# Altium schematic sheet Intel16_UNI3_Q1.SchDoc
size A3; SheetNumber: 11; SheetTotal: 15
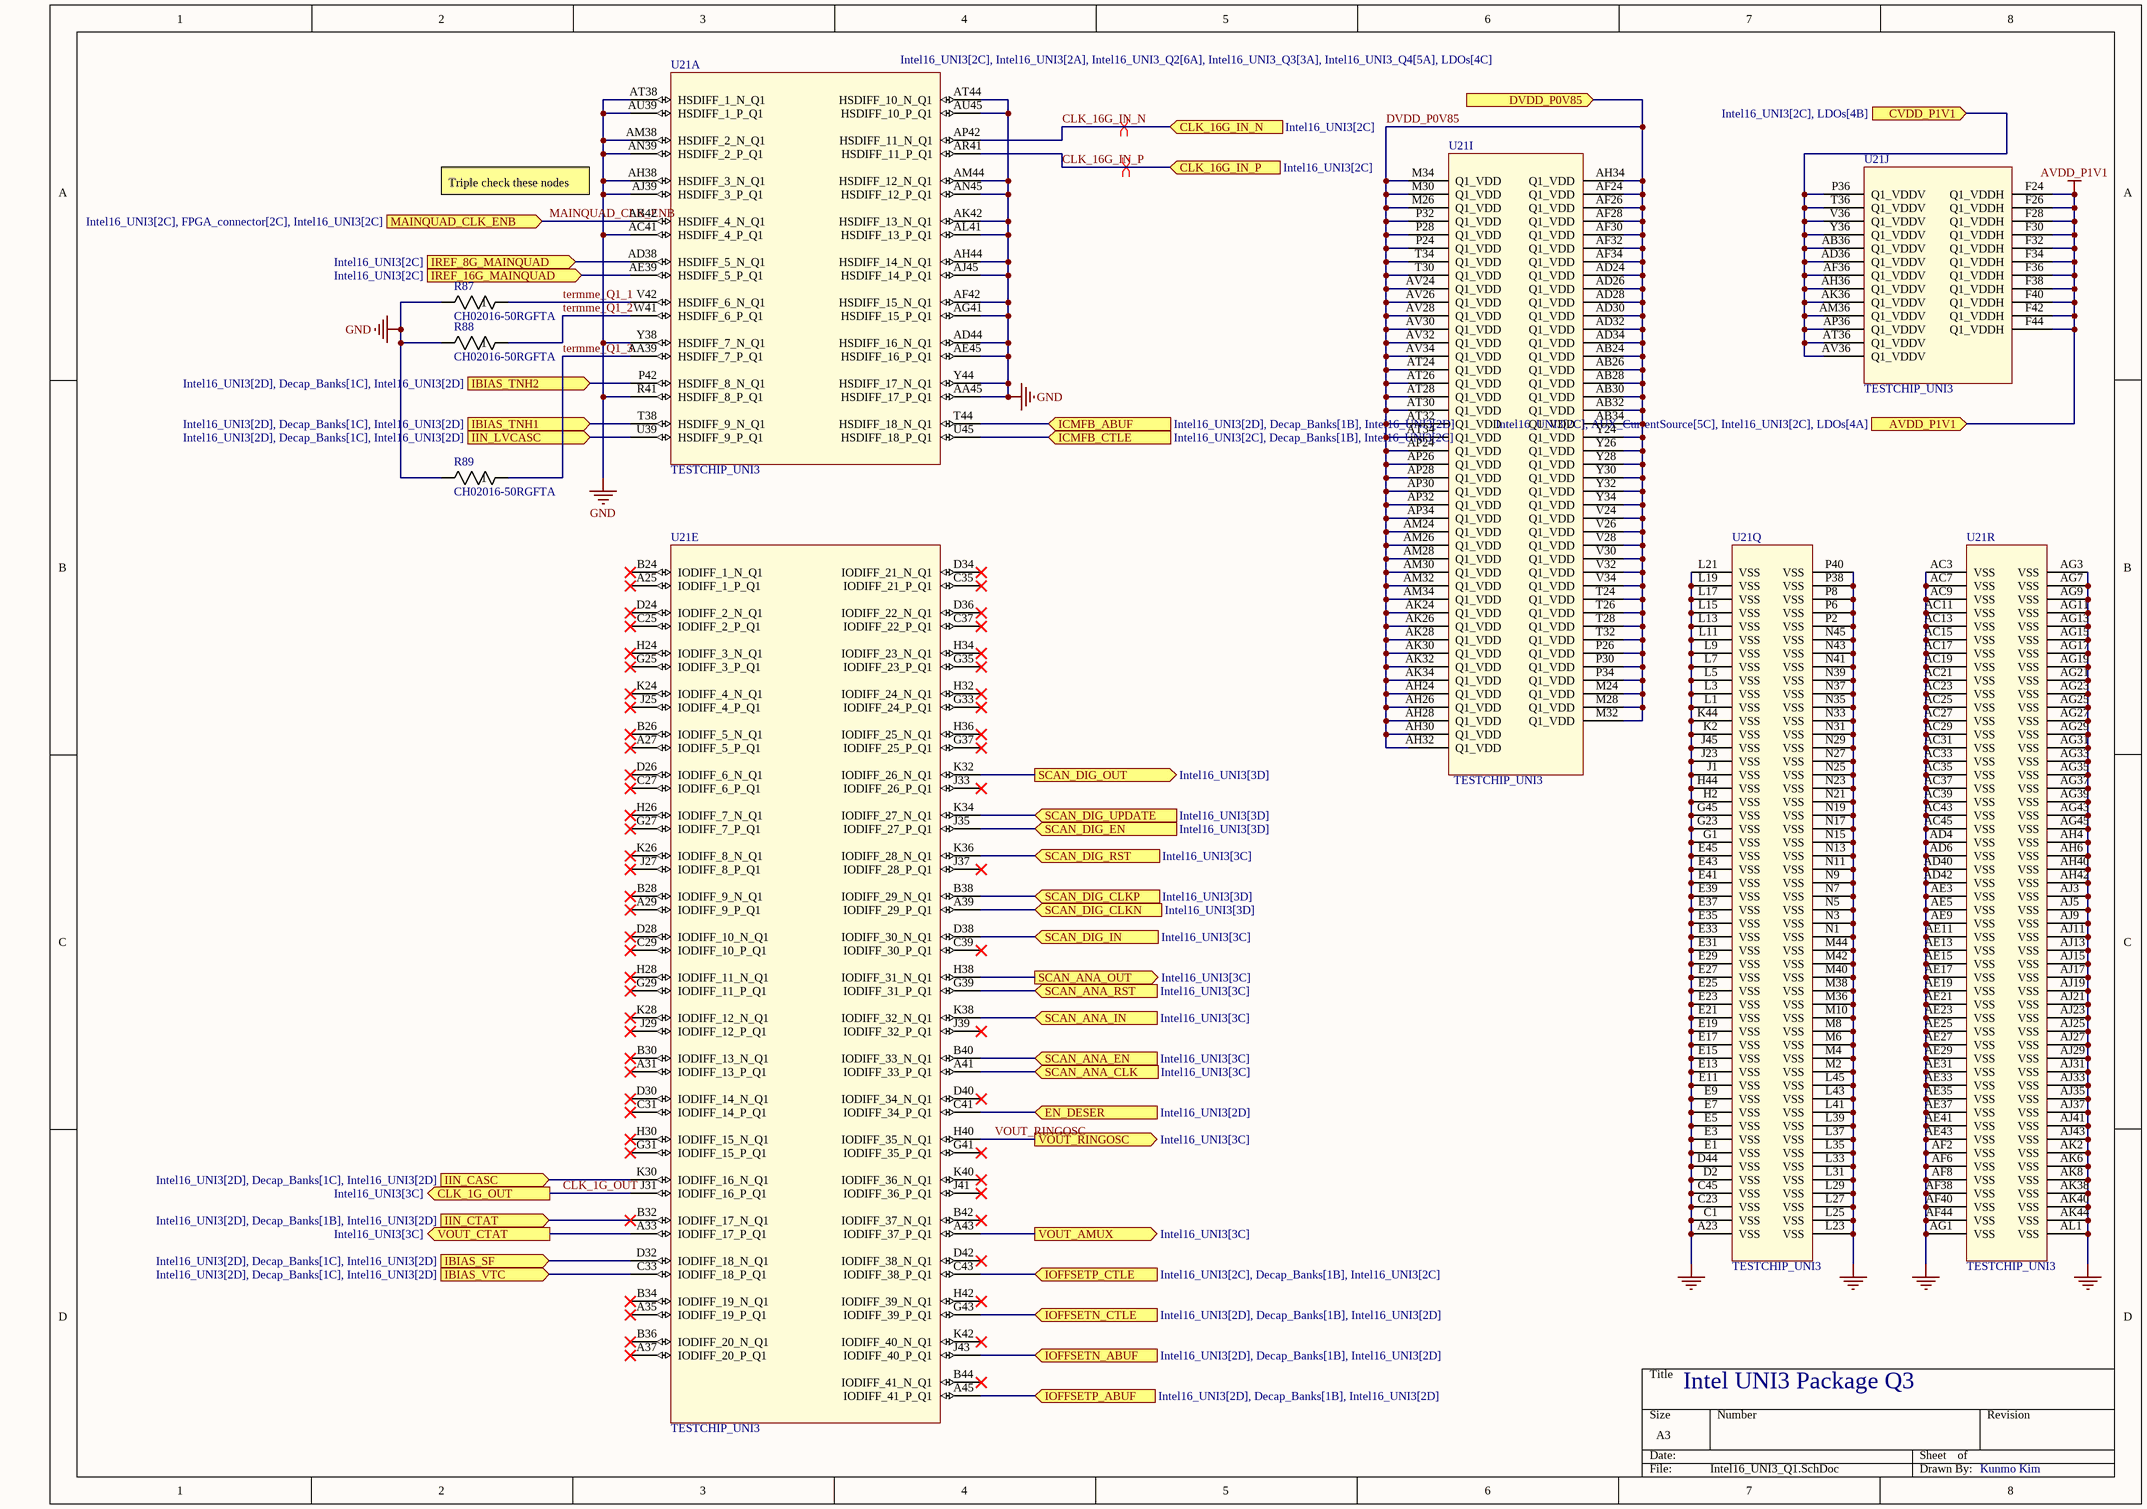
[diagram p0: Intel16_UNI3_Q1.SchDoc]

## Parts
R87  CH02016-50RGFTA  [RES_CH02016_VIS]
R88  CH02016-50RGFTA  [RES_CH02016_VIS]
R89  CH02016-50RGFTA  [RES_CH02016_VIS]
U21  TESTCHIP_UNI3  [BGA-1733-.92-37.5X37.5]  (parts A,E,I,J,Q,R of 25)

## Ports
AVDD_P1V1 (in, see Intel16_UNI3[2C], AUX_CurrentSource[5C], Intel16_UNI3[2C], LDOs[4A]), CLK_1G_OUT (out, see Intel16_UNI3[3C]), CLK_16G_IN_N (in, see Intel16_UNI3[2C]), CLK_16G_IN_P (in, see Intel16_UNI3[2C]), CVDD_P1V1 (in, see Intel16_UNI3[2C], LDOs[4B]), DVDD_P0V85 (in, see Intel16_UNI3[2C], Intel16_UNI3[2A], Intel16_UNI3_Q2[6A], Intel16_UNI3_Q3[3A], Intel16_UNI3_Q4[5A], LDOs[4C]), EN_DESER (in, see Intel16_UNI3[2D]), IBIAS_SF (in, see Intel16_UNI3[2D], Decap_Banks[1C], Intel16_UNI3[2D]), IBIAS_TNH1 (in, see Intel16_UNI3[2D], Decap_Banks[1C], Intel16_UNI3[2D]), IBIAS_TNH2 (in, see Intel16_UNI3[2D], Decap_Banks[1C], Intel16_UNI3[2D]), IBIAS_VTC (in, see Intel16_UNI3[2D], Decap_Banks[1C], Intel16_UNI3[2D]), ICMFB_ABUF (in, see Intel16_UNI3[2D], Decap_Banks[1B], Intel16_UNI3[2D]), ICMFB_CTLE (in, see Intel16_UNI3[2C], Decap_Banks[1B], Intel16_UNI3[2C]), IIN_CASC (in, see Intel16_UNI3[2D], Decap_Banks[1C], Intel16_UNI3[2D]), IIN_CTAT (in, see Intel16_UNI3[2D], Decap_Banks[1B], Intel16_UNI3[2D]), IIN_LVCASC (in, see Intel16_UNI3[2D], Decap_Banks[1C], Intel16_UNI3[2D]), IOFFSETN_ABUF (in, see Intel16_UNI3[2D], Decap_Banks[1B], Intel16_UNI3[2D]), IOFFSETN_CTLE (in, see Intel16_UNI3[2D], Decap_Banks[1B], Intel16_UNI3[2D]), IOFFSETP_ABUF (in, see Intel16_UNI3[2D], Decap_Banks[1B], Intel16_UNI3[2D]), IOFFSETP_CTLE (in, see Intel16_UNI3[2C], Decap_Banks[1B], Intel16_UNI3[2C]), IREF_8G_MAINQUAD (in, see Intel16_UNI3[2C]), IREF_16G_MAINQUAD (in, see Intel16_UNI3[2C]), MAINQUAD_CLK_ENB (in, see Intel16_UNI3[2C], FPGA_connector[2C], Intel16_UNI3[2C]), SCAN_ANA_CLK (in, see Intel16_UNI3[3C]), SCAN_ANA_EN (in, see Intel16_UNI3[3C]), SCAN_ANA_IN (in, see Intel16_UNI3[3C]), SCAN_ANA_OUT (out, see Intel16_UNI3[3C]), SCAN_ANA_RST (in, see Intel16_UNI3[3C]), SCAN_DIG_CLKN (in, see Intel16_UNI3[3D]), SCAN_DIG_CLKP (in, see Intel16_UNI3[3D]), SCAN_DIG_EN (in, see Intel16_UNI3[3D]), SCAN_DIG_IN (in, see Intel16_UNI3[3C]), SCAN_DIG_OUT (out, see Intel16_UNI3[3D]), SCAN_DIG_RST (in, see Intel16_UNI3[3C]), SCAN_DIG_UPDATE (in, see Intel16_UNI3[3D]), VOUT_AMUX (out, see Intel16_UNI3[3C]), VOUT_CTAT (out, see Intel16_UNI3[3C]), VOUT_RINGOSC (out, see Intel16_UNI3[3C])

## Nets
AVDD_P1V1: U21.F24(Q1_VDDH) U21.F26(Q1_VDDH) U21.F28(Q1_VDDH) U21.F30(Q1_VDDH) U21.F32(Q1_VDDH) U21.F34(Q1_VDDH) U21.F36(Q1_VDDH) U21.F38(Q1_VDDH) U21.F40(Q1_VDDH) U21.F42(Q1_VDDH) U21.F44(Q1_VDDH) ; port AVDD_P1V1
GND: R87.2 R88.2 R89.2 U21.A23(VSS) U21.AA45(HSDIFF_17_P_Q1) U21.AC3(VSS) U21.AC7(VSS) U21.AC9(VSS) U21.AC11(VSS) U21.AC13(VSS) U21.AC15(VSS) U21.AC17(VSS) U21.AC19(VSS) U21.AC21(VSS) U21.AC23(VSS) U21.AC25(VSS) U21.AC27(VSS) U21.AC29(VSS) U21.AC31(VSS) U21.AC33(VSS) U21.AC35(VSS) U21.AC37(VSS) U21.AC39(VSS) U21.AC41(HSDIFF_4_P_Q1) U21.AC43(VSS) U21.AC45(VSS) U21.AD4(VSS) U21.AD6(VSS) U21.AD40(VSS) U21.AD42(VSS) U21.AD44(HSDIFF_16_N_Q1) U21.AE3(VSS) U21.AE5(VSS) U21.AE9(VSS) U21.AE11(VSS) U21.AE13(VSS) U21.AE15(VSS) U21.AE17(VSS) U21.AE19(VSS) U21.AE21(VSS) U21.AE23(VSS) U21.AE25(VSS) U21.AE27(VSS) U21.AE29(VSS) U21.AE31(VSS) U21.AE33(VSS) U21.AE35(VSS) U21.AE37(VSS) U21.AE41(VSS) U21.AE43(VSS) U21.AE45(HSDIFF_16_P_Q1) U21.AF2(VSS) U21.AF6(VSS) U21.AF8(VSS) U21.AF38(VSS) U21.AF40(VSS) U21.AF42(HSDIFF_15_N_Q1) U21.AF44(VSS) U21.AG1(VSS) U21.AG3(VSS) U21.AG7(VSS) U21.AG9(VSS) U21.AG11(VSS) U21.AG13(VSS) U21.AG15(VSS) U21.AG17(VSS) U21.AG19(VSS) U21.AG21(VSS) U21.AG23(VSS) U21.AG25(VSS) U21.AG27(VSS) U21.AG29(VSS) U21.AG31(VSS) U21.AG33(VSS) U21.AG35(VSS) U21.AG37(VSS) U21.AG39(VSS) U21.AG41(HSDIFF_15_P_Q1) U21.AG43(VSS) U21.AG45(VSS) U21.AH4(VSS) U21.AH6(VSS) U21.AH38(HSDIFF_3_N_Q1) U21.AH40(VSS) U21.AH42(VSS) U21.AH44(HSDIFF_14_N_Q1) U21.AJ3(VSS) U21.AJ5(VSS) U21.AJ9(VSS) U21.AJ11(VSS) U21.AJ13(VSS) U21.AJ15(VSS) U21.AJ17(VSS) U21.AJ19(VSS) U21.AJ21(VSS) U21.AJ23(VSS) U21.AJ25(VSS) U21.AJ27(VSS) U21.AJ29(VSS) U21.AJ31(VSS) U21.AJ33(VSS) U21.AJ35(VSS) U21.AJ37(VSS) U21.AJ39(HSDIFF_3_P_Q1) U21.AJ41(VSS) U21.AJ43(VSS) U21.AJ45(HSDIFF_14_P_Q1) U21.AK2(VSS) U21.AK6(VSS) U21.AK8(VSS) U21.AK38(VSS) U21.AK40(VSS) U21.AK42(HSDIFF_13_N_Q1) U21.AK44(VSS) U21.AL1(VSS) U21.AL41(HSDIFF_13_P_Q1) U21.AM38(HSDIFF_2_N_Q1) U21.AM44(HSDIFF_12_N_Q1) U21.AN39(HSDIFF_2_P_Q1) U21.AN45(HSDIFF_12_P_Q1) U21.AT38(HSDIFF_1_N_Q1) U21.AT44(HSDIFF_10_N_Q1) U21.AU39(HSDIFF_1_P_Q1) U21.AU45(HSDIFF_10_P_Q1) U21.C1(VSS) U21.C23(VSS) U21.C45(VSS) U21.D2(VSS) U21.D44(VSS) U21.E1(VSS) U21.E3(VSS) U21.E5(VSS) U21.E7(VSS) U21.E9(VSS) U21.E11(VSS) U21.E13(VSS) U21.E15(VSS) U21.E17(VSS) U21.E19(VSS) U21.E21(VSS) U21.E23(VSS) U21.E25(VSS) U21.E27(VSS) U21.E29(VSS) U21.E31(VSS) U21.E33(VSS) U21.E35(VSS) U21.E37(VSS) U21.E39(VSS) U21.E41(VSS) U21.E43(VSS) U21.E45(VSS) U21.G1(VSS) U21.G23(VSS) U21.G45(VSS) U21.H2(VSS) U21.H44(VSS) U21.J1(VSS) U21.J23(VSS) U21.J45(VSS) U21.K2(VSS) U21.K44(VSS) U21.L1(VSS) U21.L3(VSS) U21.L5(VSS) U21.L7(VSS) U21.L9(VSS) U21.L11(VSS) U21.L13(VSS) U21.L15(VSS) U21.L17(VSS) U21.L19(VSS) U21.L21(VSS) U21.L23(VSS) U21.L25(VSS) U21.L27(VSS) U21.L29(VSS) U21.L31(VSS) U21.L33(VSS) U21.L35(VSS) U21.L37(VSS) U21.L39(VSS) U21.L41(VSS) U21.L43(VSS) U21.L45(VSS) U21.M2(VSS) U21.M4(VSS) U21.M6(VSS) U21.M8(VSS) U21.M10(VSS) U21.M36(VSS) U21.M38(VSS) U21.M40(VSS) U21.M42(VSS) U21.M44(VSS) U21.N1(VSS) U21.N3(VSS) U21.N5(VSS) U21.N7(VSS) U21.N9(VSS) U21.N11(VSS) U21.N13(VSS) U21.N15(VSS) U21.N17(VSS) U21.N19(VSS) U21.N21(VSS) U21.N23(VSS) U21.N25(VSS) U21.N27(VSS) U21.N29(VSS) U21.N31(VSS) U21.N33(VSS) U21.N35(VSS) U21.N37(VSS) U21.N39(VSS) U21.N41(VSS) U21.N43(VSS) U21.N45(VSS) U21.P2(VSS) U21.P6(VSS) U21.P8(VSS) U21.P38(VSS) U21.P40(VSS) U21.R41(HSDIFF_8_P_Q1) U21.Y38(HSDIFF_7_N_Q1) U21.Y44(HSDIFF_17_N_Q1)
CLK_1G_OUT: U21.J31(IODIFF_16_P_Q1) ; port CLK_1G_OUT
CLK_16G_IN_N: U21.AP42(HSDIFF_11_N_Q1) ; port CLK_16G_IN_N
CLK_16G_IN_P: U21.AR41(HSDIFF_11_P_Q1) ; port CLK_16G_IN_P
CVDD_P1V1: U21.AB36(Q1_VDDV) U21.AD36(Q1_VDDV) U21.AF36(Q1_VDDV) U21.AH36(Q1_VDDV) U21.AK36(Q1_VDDV) U21.AM36(Q1_VDDV) U21.AP36(Q1_VDDV) U21.AT36(Q1_VDDV) U21.AV36(Q1_VDDV) U21.P36(Q1_VDDV) U21.T36(Q1_VDDV) U21.V36(Q1_VDDV) U21.Y36(Q1_VDDV) ; port CVDD_P1V1
DVDD_P0V85: U21.AB24(Q1_VDD) U21.AB26(Q1_VDD) U21.AB28(Q1_VDD) U21.AB30(Q1_VDD) U21.AB32(Q1_VDD) U21.AB34(Q1_VDD) U21.AD24(Q1_VDD) U21.AD26(Q1_VDD) U21.AD28(Q1_VDD) U21.AD30(Q1_VDD) U21.AD32(Q1_VDD) U21.AD34(Q1_VDD) U21.AF24(Q1_VDD) U21.AF26(Q1_VDD) U21.AF28(Q1_VDD) U21.AF30(Q1_VDD) U21.AF32(Q1_VDD) U21.AF34(Q1_VDD) U21.AH24(Q1_VDD) U21.AH26(Q1_VDD) U21.AH28(Q1_VDD) U21.AH30(Q1_VDD) U21.AH32(Q1_VDD) U21.AH34(Q1_VDD) U21.AK24(Q1_VDD) U21.AK26(Q1_VDD) U21.AK28(Q1_VDD) U21.AK30(Q1_VDD) U21.AK32(Q1_VDD) U21.AK34(Q1_VDD) U21.AM24(Q1_VDD) U21.AM26(Q1_VDD) U21.AM28(Q1_VDD) U21.AM30(Q1_VDD) U21.AM32(Q1_VDD) U21.AM34(Q1_VDD) U21.AP24(Q1_VDD) U21.AP26(Q1_VDD) U21.AP28(Q1_VDD) U21.AP30(Q1_VDD) U21.AP32(Q1_VDD) U21.AP34(Q1_VDD) U21.AT24(Q1_VDD) U21.AT26(Q1_VDD) U21.AT28(Q1_VDD) U21.AT30(Q1_VDD) U21.AT32(Q1_VDD) U21.AT34(Q1_VDD) U21.AV24(Q1_VDD) U21.AV26(Q1_VDD) U21.AV28(Q1_VDD) U21.AV30(Q1_VDD) U21.AV32(Q1_VDD) U21.AV34(Q1_VDD) U21.M24(Q1_VDD) U21.M26(Q1_VDD) U21.M28(Q1_VDD) U21.M30(Q1_VDD) U21.M32(Q1_VDD) U21.M34(Q1_VDD) U21.P24(Q1_VDD) U21.P26(Q1_VDD) U21.P28(Q1_VDD) U21.P30(Q1_VDD) U21.P32(Q1_VDD) U21.P34(Q1_VDD) U21.T24(Q1_VDD) U21.T26(Q1_VDD) U21.T28(Q1_VDD) U21.T30(Q1_VDD) U21.T32(Q1_VDD) U21.T34(Q1_VDD) U21.V24(Q1_VDD) U21.V26(Q1_VDD) U21.V28(Q1_VDD) U21.V30(Q1_VDD) U21.V32(Q1_VDD) U21.V34(Q1_VDD) U21.Y24(Q1_VDD) U21.Y26(Q1_VDD) U21.Y28(Q1_VDD) U21.Y30(Q1_VDD) U21.Y32(Q1_VDD) U21.Y34(Q1_VDD) ; port DVDD_P0V85
EN_DESER: U21.C41(IODIFF_34_P_Q1) ; port EN_DESER
IBIAS_SF: U21.D32(IODIFF_18_N_Q1) ; port IBIAS_SF
IBIAS_TNH1: U21.T38(HSDIFF_9_N_Q1) ; port IBIAS_TNH1
IBIAS_TNH2: U21.P42(HSDIFF_8_N_Q1) ; port IBIAS_TNH2
IBIAS_VTC: U21.C33(IODIFF_18_P_Q1) ; port IBIAS_VTC
ICMFB_ABUF: U21.T44(HSDIFF_18_N_Q1) ; port ICMFB_ABUF
ICMFB_CTLE: U21.U45(HSDIFF_18_P_Q1) ; port ICMFB_CTLE
IIN_CASC: U21.K30(IODIFF_16_N_Q1) ; port IIN_CASC
IIN_CTAT: U21.B32(IODIFF_17_N_Q1) ; port IIN_CTAT
IIN_LVCASC: U21.U39(HSDIFF_9_P_Q1) ; port IIN_LVCASC
IOFFSETN_ABUF: U21.J43(IODIFF_40_P_Q1) ; port IOFFSETN_ABUF
IOFFSETN_CTLE: U21.G43(IODIFF_39_P_Q1) ; port IOFFSETN_CTLE
IOFFSETP_ABUF: U21.A45(IODIFF_41_P_Q1) ; port IOFFSETP_ABUF
IOFFSETP_CTLE: U21.C43(IODIFF_38_P_Q1) ; port IOFFSETP_CTLE
IREF_8G_MAINQUAD: U21.AD38(HSDIFF_5_N_Q1) ; port IREF_8G_MAINQUAD
IREF_16G_MAINQUAD: U21.AE39(HSDIFF_5_P_Q1) ; port IREF_16G_MAINQUAD
MAINQUAD_CLK_ENB: U21.AB42(HSDIFF_4_N_Q1) ; port MAINQUAD_CLK_ENB
SCAN_ANA_CLK: U21.A41(IODIFF_33_P_Q1) ; port SCAN_ANA_CLK
SCAN_ANA_EN: U21.B40(IODIFF_33_N_Q1) ; port SCAN_ANA_EN
SCAN_ANA_IN: U21.K38(IODIFF_32_N_Q1) ; port SCAN_ANA_IN
SCAN_ANA_OUT: U21.H38(IODIFF_31_N_Q1) ; port SCAN_ANA_OUT
SCAN_ANA_RST: U21.G39(IODIFF_31_P_Q1) ; port SCAN_ANA_RST
SCAN_DIG_CLKN: U21.A39(IODIFF_29_P_Q1) ; port SCAN_DIG_CLKN
SCAN_DIG_CLKP: U21.B38(IODIFF_29_N_Q1) ; port SCAN_DIG_CLKP
SCAN_DIG_EN: U21.J35(IODIFF_27_P_Q1) ; port SCAN_DIG_EN
SCAN_DIG_IN: U21.D38(IODIFF_30_N_Q1) ; port SCAN_DIG_IN
SCAN_DIG_OUT: U21.K32(IODIFF_26_N_Q1) ; port SCAN_DIG_OUT
SCAN_DIG_RST: U21.K36(IODIFF_28_N_Q1) ; port SCAN_DIG_RST
SCAN_DIG_UPDATE: U21.K34(IODIFF_27_N_Q1) ; port SCAN_DIG_UPDATE
termme_Q1_1: R87.1 U21.V42(HSDIFF_6_N_Q1)
termme_Q1_2: R88.1 U21.W41(HSDIFF_6_P_Q1)
termme_Q1_3: R89.1 U21.AA39(HSDIFF_7_P_Q1)
VOUT_AMUX: U21.A43(IODIFF_37_P_Q1) ; port VOUT_AMUX
VOUT_CTAT: U21.A33(IODIFF_17_P_Q1) ; port VOUT_CTAT
VOUT_RINGOSC: U21.H40(IODIFF_35_N_Q1) ; port VOUT_RINGOSC

Not connected (* = marked no-connect by the designer): U21 A25(IODIFF_1_P_Q1)* A27(IODIFF_5_P_Q1)* A29(IODIFF_9_P_Q1)* A31(IODIFF_13_P_Q1)* A35(IODIFF_19_P_Q1)* A37(IODIFF_20_P_Q1)* B24(IODIFF_1_N_Q1)* B26(IODIFF_5_N_Q1)* B28(IODIFF_9_N_Q1)* B30(IODIFF_13_N_Q1)* B34(IODIFF_19_N_Q1)* B36(IODIFF_20_N_Q1)* B42(IODIFF_37_N_Q1)* B44(IODIFF_41_N_Q1)* C25(IODIFF_2_P_Q1)* C27(IODIFF_6_P_Q1)* C29(IODIFF_10_P_Q1)* C31(IODIFF_14_P_Q1)* C35(IODIFF_21_P_Q1)* C37(IODIFF_22_P_Q1)* C39(IODIFF_30_P_Q1)* D24(IODIFF_2_N_Q1)* D26(IODIFF_6_N_Q1)* D28(IODIFF_10_N_Q1)* D30(IODIFF_14_N_Q1)* D34(IODIFF_21_N_Q1)* D36(IODIFF_22_N_Q1)* D40(IODIFF_34_N_Q1)* D42(IODIFF_38_N_Q1)* G25(IODIFF_3_P_Q1)* G27(IODIFF_7_P_Q1)* G29(IODIFF_11_P_Q1)* G31(IODIFF_15_P_Q1)* G33(IODIFF_24_P_Q1)* G35(IODIFF_23_P_Q1)* G37(IODIFF_25_P_Q1)* G41(IODIFF_35_P_Q1)* H24(IODIFF_3_N_Q1)* H26(IODIFF_7_N_Q1)* H28(IODIFF_11_N_Q1)* H30(IODIFF_15_N_Q1)* H32(IODIFF_24_N_Q1)* H34(IODIFF_23_N_Q1)* H36(IODIFF_25_N_Q1)* H42(IODIFF_39_N_Q1)* J25(IODIFF_4_P_Q1)* J27(IODIFF_8_P_Q1)* J29(IODIFF_12_P_Q1)* J33(IODIFF_26_P_Q1)* J37(IODIFF_28_P_Q1)* J39(IODIFF_32_P_Q1)* J41(IODIFF_36_P_Q1)* K24(IODIFF_4_N_Q1)* K26(IODIFF_8_N_Q1)* K28(IODIFF_12_N_Q1)* K40(IODIFF_36_N_Q1)* K42(IODIFF_40_N_Q1)*

## Layout directives
differential pair: CLK_16G_IN_N, CLK_16G_IN_P

## Notes on the sheet
- Triple check these nodes
- Intel UNI3 Package Q3
- Kunmo Kim

## Library data of the parts
R87-R89 = CH02016-50RGFTA: High precision 50ohm 01005 termination resistor.; Mfr_Name: Vishay; Supplier 1: Mouser; Supplier Part Number 1: 71-CH02016-50RGFTA
U21 = TESTCHIP_UNI2: UNI2 interposer